# EasyEDA Pro project motor_driver.eprj

# Schematic Schematic1

## Sheets
1 P1: Create Date: 2024-08-04; Page Name: P1; Project Name: motor_driver; Schematic Name: Schematic1; Update Date: 2024-08-15; Company: 嘉立创EDA; Page Size: A4; Version: V1.0
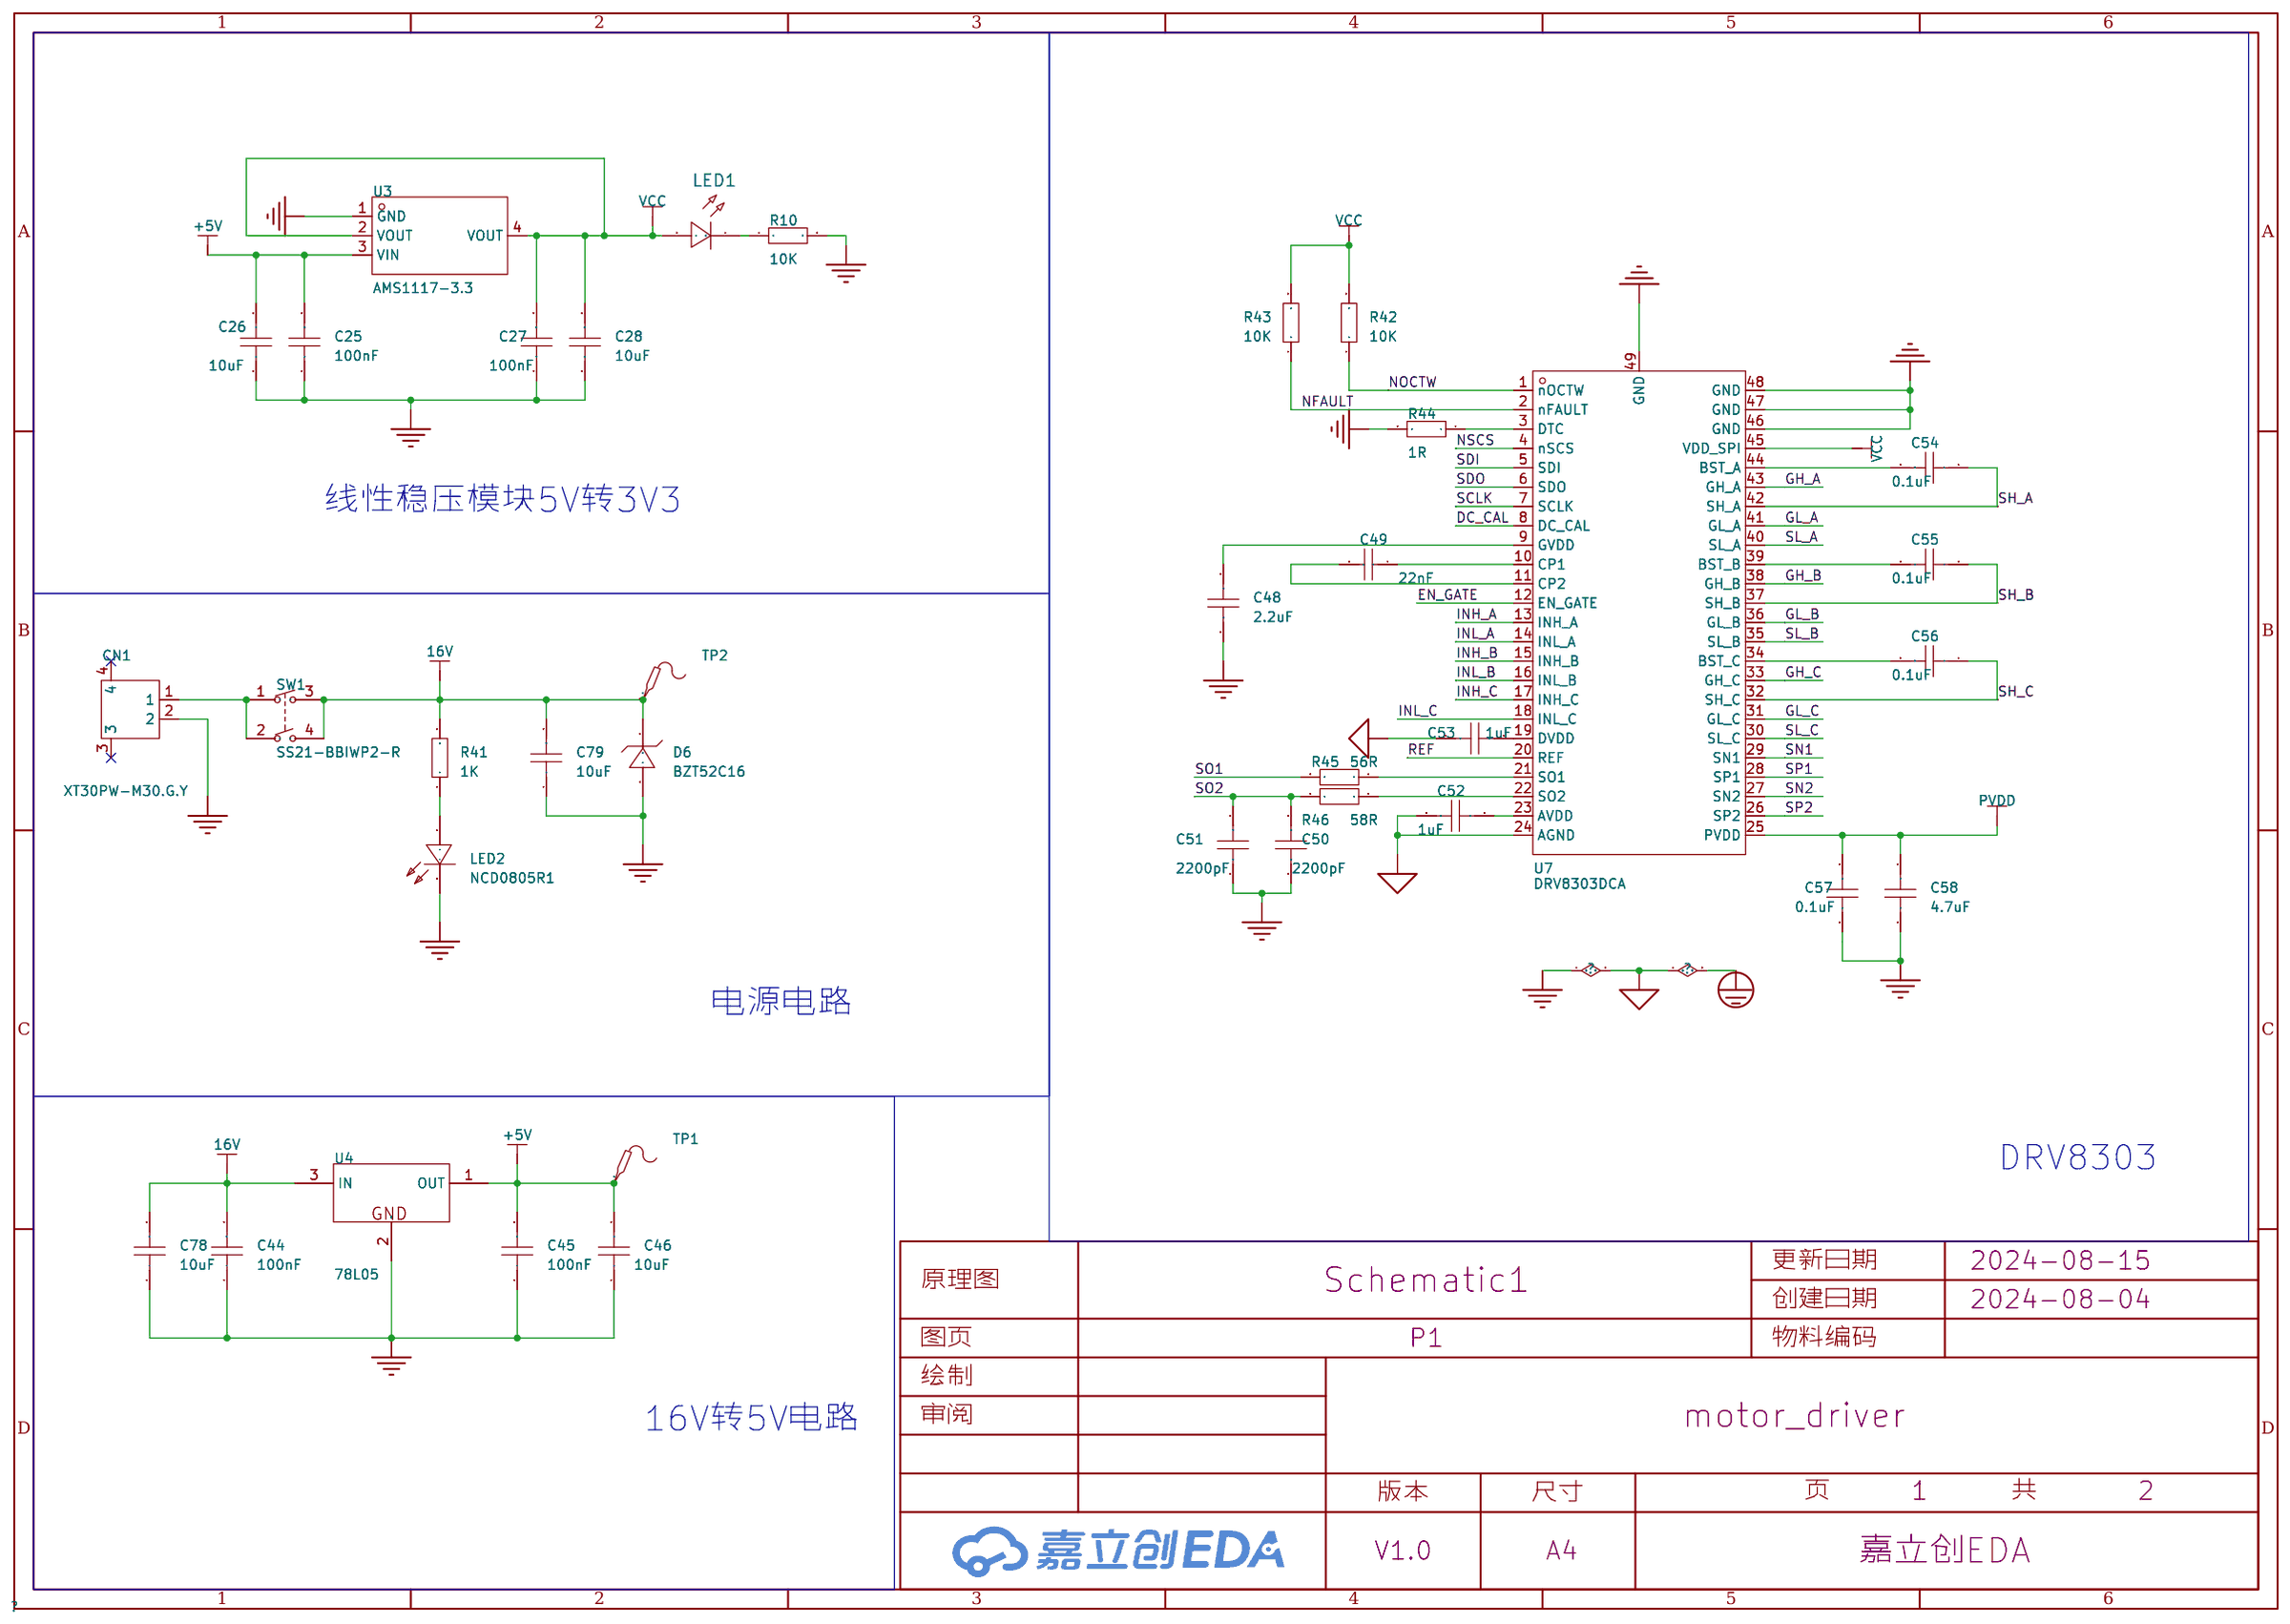
[diagram p0: P1]
2 P2: Page Name: P2; Update Date: 2024-08-27
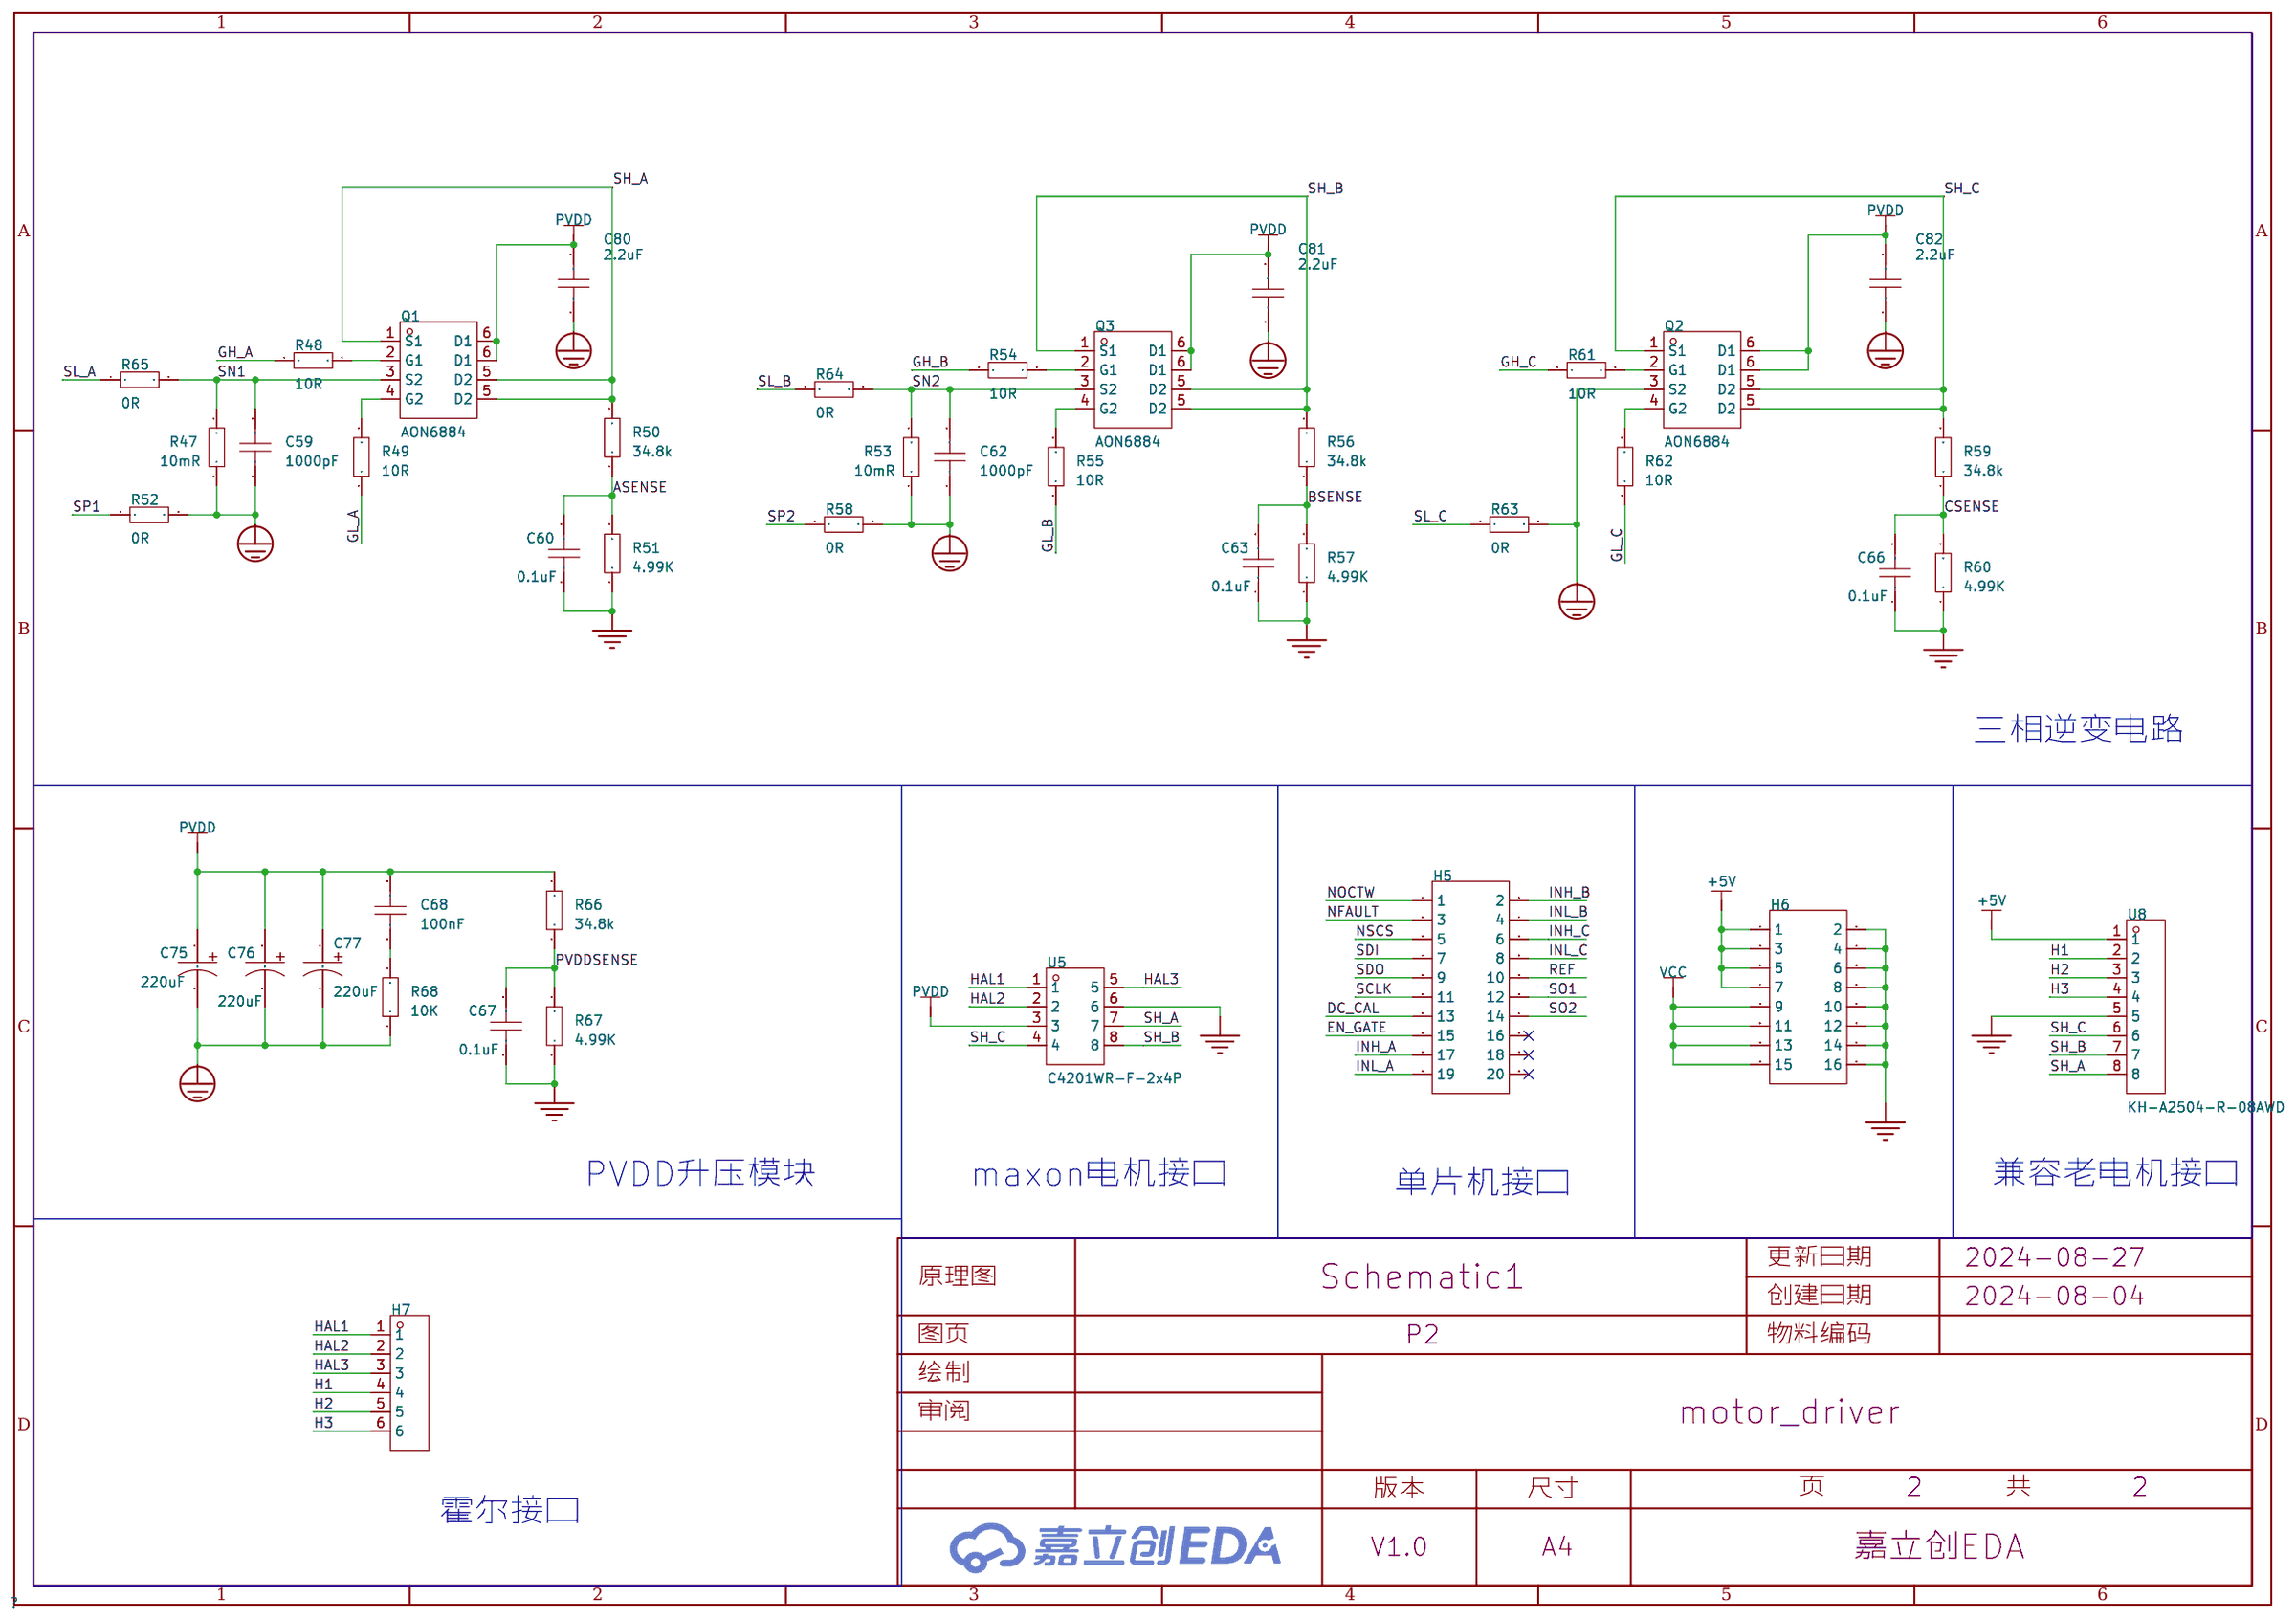
[diagram p1: P2]

## Parts
sheet P1
C25  100nF  [C0805]
C26  10uF  [C0805]
C27  100nF  [C0805]
C28  10uF  [C0805]
C44  100nF  [C0805]
C45  100nF  [C0805]
C46  10uF  [C0805]
C48  2.2uF  [C0805]
C49  22nF  [C0603]
C50  2200pF  [C0805]
C51  2200pF  [C0805]
C52  1uF  [C0805]
C53  1uF  [C0805]
C54  0.1uF  [C0805]
C55  0.1uF  [C0805]
C56  0.1uF  [C0805]
C57  0.1uF  [C0805]
C58  4.7uF  [C0805]
C78  10uF  [C0805]
C79  10uF  [C0805]
CN1  XT30PW-M30.G.Y  [CONN-TH_XT30PW-M]
D6  BZT52C16  [SOD-123_L2.7-W1.6-LS3.7-RD]
LED1  -  [LED_0805]
LED2  NCD0805R1  [LED0805-R-RD]
R10  10K  [R0805]
R41  1K  [R0603]
R42  10K  [R0603]
R43  10K  [R0603]
R44  1R  [R0603]
R45  56R  [R0603]
R46  58R  [R0603]
SW1  SS21-BBIWP2-R  [SW-TH_SS21-BBIWP2]
TP1  -  [Test-Point-0.5mm]
TP2  -  [Test-Point-0.5mm]
U3  AMS1117-3.3  [SOT-223-3_L6.5-W3.4-P2.30-LS7.0-BR]
U4  78L05  [SOT-89-3_L4.5-W2.5-P1.50-LS4.2-BR]
U7  DRV8303DCA  [HTSSOP-48_L12.5-W6.1-P0.50-LS8.1-BL-EP4.4]
sheet P2
C59  1000pF  [C0805]
C60  0.1uF  [C0603]
C62  1000pF  [C0805]
C63  0.1uF  [C0603]
C66  0.1uF  [C0603]
C67  0.1uF  [C0603]
C68  100nF  [C0805]
C75  220uF  [CAP-SMD_BD8.0-L8.3-W8.3-FD]
C76  220uF  [CAP-SMD_BD8.0-L8.3-W8.3-FD]
C77  220uF  [CAP-SMD_BD8.0-L8.3-W8.3-FD]
C80  2.2uF  [C0805]
C81  2.2uF  [C0805]
C82  2.2uF  [C0805]
H5  -  [HDR-TH_20P-P2.54-V-R2-C10-S2.54]
H6  -  [HDR-TH_16P-P2.54-V-F-R2-C8-S2.54-1]
H7  -  [HDR-TH_6P-P2.54-V-F]
Q1  AON6884  [DFN-8_L5.5-W5.2-P1.27-LS6.0-BL-EP2]
Q2  AON6884  [DFN-8_L5.5-W5.2-P1.27-LS6.0-BL-EP2]
Q3  AON6884  [DFN-8_L5.5-W5.2-P1.27-LS6.0-BL-EP2]
R47  10mR  [R0603]
R48  10R  [R0603]
R49  10R  [R0603]
R50  34.8k  [R0603]
R51  4.99K  [R0603]
R52  0R  [R0603]
R53  10mR  [R0603]
R54  10R  [R0603]
R55  10R  [R0603]
R56  34.8k  [R0603]
R57  4.99K  [R0603]
R58  0R  [R0603]
R59  34.8k  [R0603]
R60  4.99K  [R0603]
R61  10R  [R0603]
R62  10R  [R0603]
R63  0R  [R0603]
R64  0R  [R0603]
R65  0R  [R0603]
R66  34.8k  [R0603]
R67  4.99K  [R0603]
R68  10K  [R0603]
U5  C4201WR-F-2x4P  [CONN-TH_C4201WR-F-2X4P]
U8  KH-A2504-R-08AWD  [CONN-TH_8P-P2.50_KH-A2504-R-08AWD]

## Library data of the parts
C25-C28 C44-C46 C48 C50-C59 C62 C68 = CAP_0805: Supplier Footprint: 0805
C49 = CL10B223KB8NNNC: 容值:22nF;精度:±10%;额定电压:50V;材质(温度系数):X7R;; LCSC Part Name: 22nF ±10% 50V; Supplier Part: C21122; Manufacturer: SAMSUNG(三星); Supplier Footprint: 0603; JLCPCB Part Class: 基础库; Datasheet: https://atta.szlcsc.com/upload/public/pdf/source/20160218/1457707763339.pdf; Supplier: LCSC; Tolerance: ±10%; Voltage Rated: 50V; Temperature Coefficient: X7R
C78 C79 = CL21A106KAYNNNE_C15850: 容值:10uF;精度:±10%;额定电压:25V;材质(温度系数):X5R;; LCSC Part Name: 10uF ±10% 25V; Supplier Part: C15850; Manufacturer: SAMSUNG(三星); Manufacturer Part: CL21A106KAYNNNE; Supplier Footprint: 0805; JLCPCB Part Class: 基础库; Datasheet: https://atta.szlcsc.com/upload/public/pdf/source/20160218/1457707763339.pdf; Supplier: LCSC; Tolerance: ±10%; Voltage Rated: 25V; Temperature Coefficient: X5R
CN1 = XT30PW-M30.G.Y: 类别:-;类型1:-;; LCSC Part Name: AMASS(艾迈斯)航模插头 卧式弯脚 XT30PW-M公头; Supplier Part: C431092; Manufacturer: AMASS(艾迈斯); JLCPCB Part Class: Extended Part; Datasheet: https://atta.szlcsc.com/upload/public/pdf/source/20220222/6A9F22F7850E25B33E1BE430ADF8560B.pdf; Supplier: LCSC; Type: 航模插头; RatedVoltage: DC 500V; InterfaceType: 公头; RatedCurrent: 15A; RecommendedWireGauge: 16/18/20AWG; contact resistance: 1.2mΩ; specifications: 2pin
D6 = BZT52C16_C216724: 二极管配置:独立式;稳压值(标称值):16V;稳压值(范围):15.3V~17.1V;功率:500mW;精度:±5%;; Supplier Part: C216724; Manufacturer: SHIKUES(时科); Supplier Footprint: SOD-123; JLCPCB Part Class: 扩展库; Datasheet: https://atta.szlcsc.com/upload/public/pdf/source/20180521/C216736_0F7817A5B0D519AB82EE72E876335F07.pdf; Supplier: LCSC; Diode Configuration: 独立式; Zener Voltage (Nom): 16V; Reverse Leakage Current (Ir): 100nA@12V; Zener Voltage (Range): 15.3V~17.1V; Power Dissipation: 500mW; Zener Impedance (Zzt): 40Ω; Tolerance: ±5%
LED1 = LED_0805-R: Supplier Footprint: 0805
LED2 = NCD0805R1: 灯头类型:-;发光颜色:红色;正向电压(VF):1.6V~2.6V;功率:65mW;正向电流:20mA;主波长:615nm~630nm;二极管配置:独立二极管;透镜颜色:无色透明透镜;色温:-;发光强度:67mcd~195mcd;发光角度:130°;载带方式:-;工作温度:-30℃~+85℃;; Supplier Part: C84256; Manufacturer: 国星光电; Supplier Footprint: 0805; JLCPCB Part Class: 基础库; Datasheet: https://atta.szlcsc.com/upload/public/pdf/source/20200820/C84256_F0A75A43B3EAD75808600A0514C76B99.pdf; Supplier: LCSC; Emitted Color: 红色; Forward Voltage (VF): 1.6V~2.6V; Power Dissipation: 65mW; Forward Current: 20mA; Dominant Wavelength: 615nm~630nm; Diode Configuration: 独立二极管; Lens Color: 无色透明透镜; Luminous Intensity: 67mcd~195mcd; Viewing Angle: 130°; Operating Temperature: -30℃~+85℃
R10 = Res_0805: Supplier Footprint: 0805
R41-R68 = Res_0603: Supplier Footprint: 0603
SW1 = SS21-BBIWP2-R: 带灯:-;引脚样式:焊片;额定电流:10A;额定电压(AC):250V;额定电压(DC):-;电路结构:双刀单掷;机械寿命:-;; LCSC Part Name: 跷板开关DPST 15x21mm; Supplier Part: C309182; Manufacturer: Legion(六钧); Supplier Footprint: 插件; JLCPCB Part Class: 扩展库; Datasheet: https://atta.szlcsc.com/upload/public/pdf/source/20190311/C309182_BE3155CDE2291F8D537E9264D9294CC5.pdf; Supplier: LCSC; Actuator Type: 凹面弯曲; Pin Style: 焊片; Actuator Color: 黑色; Contact Current: 10A; Voltage Rating (AC): 250V; Circuit: 双刀单掷; Actuator Identifier: - O
TP1 TP2 = Test-Point: Test Point 测试点
U3 = AMS1117-3.3_C6186: 输出类型:固定;最大输入电压:-;输出电压:3.3V;最大输出电流:1A;电源纹波抑制比(PSRR):72dB@(120Hz);输出极性:正极;; LCSC Part Name: 输出3.3V 1A; Supplier Part: C6186; Manufacturer: AMS; Supplier Footprint: SOT-223; JLCPCB Part Class: 基础库; Datasheet: https://atta.szlcsc.com/upload/public/pdf/source/20180727/C6186_7A095716F0823C02F1997A905E26C086.pdf; Supplier: LCSC; Output Type: 固定; Output Voltage: 3.3V; MAX Output Current: 1A; Power Supply Rejection Ratio (PSRR): 72dB@(120Hz); Dropout Voltage: 1.3V@(800mA); Output Polarity: 正极; Number of Outputs: 1
U4 = 78L05_C347258: 输出类型:固定;最大输入电压:30V;输出电压:5V;最大输出电流:100mA;电源纹波抑制比(PSRR):49dB@(120Hz);输出极性:正极;; LCSC Part Name: 输入30V 输出5V 100mA; Supplier Part: C347258; Manufacturer: UMW(友台半导体); Supplier Footprint: SOT-89-3; JLCPCB Part Class: 扩展库; Datasheet: https://atta.szlcsc.com/upload/public/pdf/source/20231109/E3DE607B64FB2BED1580456949804217.pdf; Supplier: LCSC; Output Type: 固定; Maximum Input Voltage: 30V; Output Voltage: 5V; MAX Output Current: 100mA; Power Supply Rejection Ratio (PSRR): 49dB@(120Hz); Dropout Voltage: 1.7V@(40mA); standby current: 5.5mA; Operating Temperature: -20℃~+120℃@(Tj); Output Polarity: 正极; Number of Outputs: 1
U7 = DRV8303DCA: DRV8303 具有电流分流放大器和 SPI 的最大 65V 三相栅极驱动器; LCSC Part Name: 无刷直流BLDC电机驱动芯片 60V; Supplier Part: C1523892; Manufacturer: TI(德州仪器); Supplier Footprint: HTSSOP-48-EP-6.1mm; JLCPCB Part Class: 扩展库; Datasheet: https://www.ti.com/cn/lit/gpn/drv8303; Supplier: LCSC
C60 C63 C66 C67 = CAP_0603: Supplier Footprint: 0603
C75-C77 = 20SVPK220M: 容值:220uF;精度:±20%;额定电压:20V;纹波电流:1.01A@100kHz;等效串联电阻:25mΩ@100kHz~300kHz;类型:聚合物;; LCSC Part Name: 220uF ±20% 20V; Supplier Part: C454650; Manufacturer: PANASONIC(松下); Supplier Footprint: SMD,D8xL6.9mm; JLCPCB Part Class: 扩展库; Supplier: LCSC; Tolerance: ±20%; Rated Voltage: 20V; Ripple Current: 1.01A@100kHz; Equivalent Series Resistance(ESR): 25mΩ@100kHz~300kHz; Type: 聚合物; φD: 8mm; L: 6.9mm; Lifetime @ Temp: 100hrs@125℃; Operating Temperature: -55℃~+125℃
C80-C82 = CL21A225KBQNNNE: 容值:2.2uF;精度:±10%;额定电压:50V;材质(温度系数):X5R;; LCSC Part Name: 2.2uF ±10% 50V; Supplier Part: C377773; Manufacturer: SAMSUNG(三星); Supplier Footprint: 0805; JLCPCB Part Class: 基础库; Datasheet: https://atta.szlcsc.com/upload/public/pdf/source/20160218/1457707763339.pdf; Supplier: LCSC; Tolerance: ±10%; Voltage Rated: 50V; Temperature Coefficient: X5R
H5 = HDR-F_2.54_2x10: Supplier Part: C30867; Supplier Footprint: 插件
H6 = HDR-F_2.54_2x8: Supplier Part: C30734; Supplier Footprint: 插件
H7 = HDR-F_2.54_1x6P: Supplier Part: C40877; Supplier Footprint: 插件
Q1-Q3 = AON6884: 类型:2个N沟道;漏源电压(Vdss):40V;连续漏极电流(Id):9A;功率(Pd):1.6W;导通电阻(RDS(on)@Vgs,Id):11.3mΩ@10V,10A;阈值电压(Vgs(th)@Id):2.7V@250uA;; LCSC Part Name: 2个N沟道 耐压:40V 电流:9A; Supplier Part: C125872; Manufacturer: AOS; Supplier Footprint: DFN-8(5.2x5.5); JLCPCB Part Class: 扩展库; Datasheet: https://atta.szlcsc.com/upload/public/pdf/source/20180326/C125872_34AF0DD57D8DED273B86A053347F87CE.pdf; Supplier: LCSC; Type: 2个N沟道; Drain Source Voltage (Vdss): 40V; Continuous Drain Current (Id): 9A; Power Dissipation (Pd): 1.6W; Drain Source On Resistance (RDS(on)@Vgs,Id): 11.3mΩ@10V,10A; Gate Threshold Voltage (Vgs(th)@Id): 2.7V@250uA
U5 = C4201WR-F-2x4P_C5333426: Supplier Part: C5333426; Manufacturer: CJT(长江连接器); Supplier Footprint: 弯插,P=4.2mm; JLCPCB Part Class: 扩展库; Datasheet: https://atta.szlcsc.com/upload/public/pdf/source/20210326/C2764355_A41BE8F3AF9C3DD861E3A84F228C93DC.pdf; Supplier: LCSC
U8 = KH-A2504-R-08AWD: 插针结构:1x8P;间距:2.54mm;安装方式:弯插;总PIN数:8P;排数:1;每排PIN数:8;; LCSC Part Name: 间距:2.54mm 1x8P 白色; Supplier Part: C18186422; Manufacturer: kinghelm(金航标); Supplier Footprint: 插件,P=2.5mm; JLCPCB Part Class: 扩展库; Datasheet: https://atta.szlcsc.com/upload/public/pdf/source/20230919/6D15C2409625FC46455D302EA5C53430.pdf; Supplier: LCSC; Pins Structure: 1x8P; Pitch: 2.54mm; Mounting Style: 弯插; Number of Pins: 8P; Number of Rows: 1; Number of PINs Per Row: 8

## Nets
16V: C44.2 C78.2 C79.2 D6.1(K) R41.2 SW1.3 SW1.4 TP2.1 U4.3(IN)
+5V: C25.2 C26.2 C45.2 C46.2 H6.1 H6.3 H6.5 H6.7 TP1.1 U3.3(VIN) U4.1(OUT) U8.1
AGND: C25.1 C26.1 C27.1 C28.1 C44.1 C45.1 C46.1 C48.1 C50.1 C51.1 C52.2 C53.2 C57.2 C58.2 C59.1 C60.1 C62.1 C63.1 C66.1 C67.1 C75.2 C76.2 C77.2 C78.1 C79.1 C80.1 C81.1 C82.1 CN1.2 D6.2(A) H6.2 H6.4 H6.6 H6.8 H6.10 H6.12 H6.14 H6.16 LED2.2(-) Q2.3(S2) R10.2 R44.2 R47.1 R51.1 R52.2 R53.1 R57.1 R58.2 R60.1 R63.2 R67.1 R68.1 U3.1(GND) U4.2(GND) U5.6 U7.24(AGND) U7.46(GND) U7.47(GND) U7.48(GND) U7.49(GND) U8.5
PVDD: C57.1 C58.1 C68.2 C75.1 C76.1 C77.1 C80.2 C81.2 C82.2 Q1.6(D1) Q2.6(D1) Q3.6(D1) R66.2 U5.3 U7.25(PVDD)
PVDDSENSE: C67.2 R66.1 R67.2
VCC: C27.2 C28.2 H6.9 H6.11 H6.13 H6.15 LED1.2(A) R42.2 R43.2 U3.2(VOUT) U3.4(VOUT) U7.45(VDD_SPI)
ASENSE: C60.2 R50.1 R51.2
BSENSE: C63.2 R56.1 R57.2
CSENSE: C66.2 R59.1 R60.2
DC_CAL: H5.13 U7.8(DC_CAL)
EN_GATE: H5.15 U7.12(EN_GATE)
GH_A: R48.1 U7.43(GH_A)
GH_B: R54.1 U7.38(GH_B)
GH_C: R61.1 U7.33(GH_C)
GL_A: R49.1 U7.41(GL_A)
GL_B: R55.1 U7.36(GL_B)
GL_C: R62.1 U7.31(GL_C)
H1: H7.4 U8.2
H2: H7.5 U8.3
H3: H7.6 U8.4
HAL1: H7.1 U5.1
HAL2: H7.2 U5.2
HAL3: H7.3 U5.5
INH_A: H5.17 U7.13(INH_A)
INH_B: H5.2 U7.15(INH_B)
INH_C: H5.6 U7.17(INH_C)
INL_A: H5.19 U7.14(INL_A)
INL_B: H5.4 U7.16(INL_B)
INL_C: H5.8 U7.18(INL_C)
NFAULT: H5.3 R43.1 U7.2(nFAULT)
NOCTW: H5.1 R42.1 U7.1(nOCTW)
NSCS: H5.5 U7.4(nSCS)
REF: H5.10 U7.20(REF)
SCLK: H5.11 U7.7(SCLK)
SDI: H5.7 U7.5(SDI)
SDO: H5.9 U7.6(SDO)
SH_A: C54.1 Q1.1(S1) Q1.5(D2) R50.2 U5.7 U7.42(SH_A) U8.8
SH_B: C55.1 Q3.1(S1) Q3.5(D2) R56.2 U5.8 U7.37(SH_B) U8.7
SH_C: C56.1 Q2.1(S1) Q2.5(D2) R59.2 U5.4 U7.32(SH_C) U8.6
SL_A: R65.1 U7.40(SL_A)
SL_B: R64.1 U7.35(SL_B)
SL_C: R63.1 U7.30(SL_C)
SN1: C59.2 Q1.3(S2) R47.2 R65.2 U7.29(SN1)
SN2: C62.2 Q3.3(S2) R53.2 R64.2 U7.27(SN2)
SO1: H5.12 R45.2
SO2: C50.2 C51.2 H5.14 R46.2
SP1: R52.1 U7.28(SP1)
SP2: R58.1 U7.26(SP2)
$3N286: LED1.1(C) R10.1
$3N603: CN1.1 SW1.1 SW1.2
$3N605: LED2.1(+) R41.1
$3N1469: R44.1 U7.3(DTC)
$3N1546: C48.2 U7.9(GVDD)
$3N1634: C49.1 U7.10(CP1)
$3N1637: C49.2 U7.11(CP2)
$3N1642: R45.1 U7.21(SO1)
$3N1645: R46.1 U7.22(SO2)
$3N1837: C52.1 U7.23(AVDD)
$3N1907: C53.1 U7.19(DVDD)
$3N2117: C54.2 U7.44(BST_A)
$3N2227: C56.2 U7.34(BST_C)
$3N2233: C55.2 U7.39(BST_B)
$4N615: Q1.2(G1) R48.2
$4N618: Q1.4(G2) R49.2
$4N1413: Q3.2(G1) R54.2
$4N1415: Q3.4(G2) R55.2
$4N1749: Q2.2(G1) R61.2
$4N1755: Q2.4(G2) R62.2
$4N2179: C68.1 R68.2

Not connected (* = marked no-connect by the designer): CN1 3* 4*; H5 16* 18* 20*

## Notes on the sheets
sheet 1
- 线性稳压模块5V转3V3
- 电源电路
- DRV8303
- 16V转5V电路
sheet 2
- 三相逆变电路
- PVDD升压模块
- maxon电机接口
- 单片机接口
- 兼容老电机接口
- 霍尔接口

# Board PCB1